# EasyEDA Pro project FPGA-G1.eprj, board logi Pi (continued)
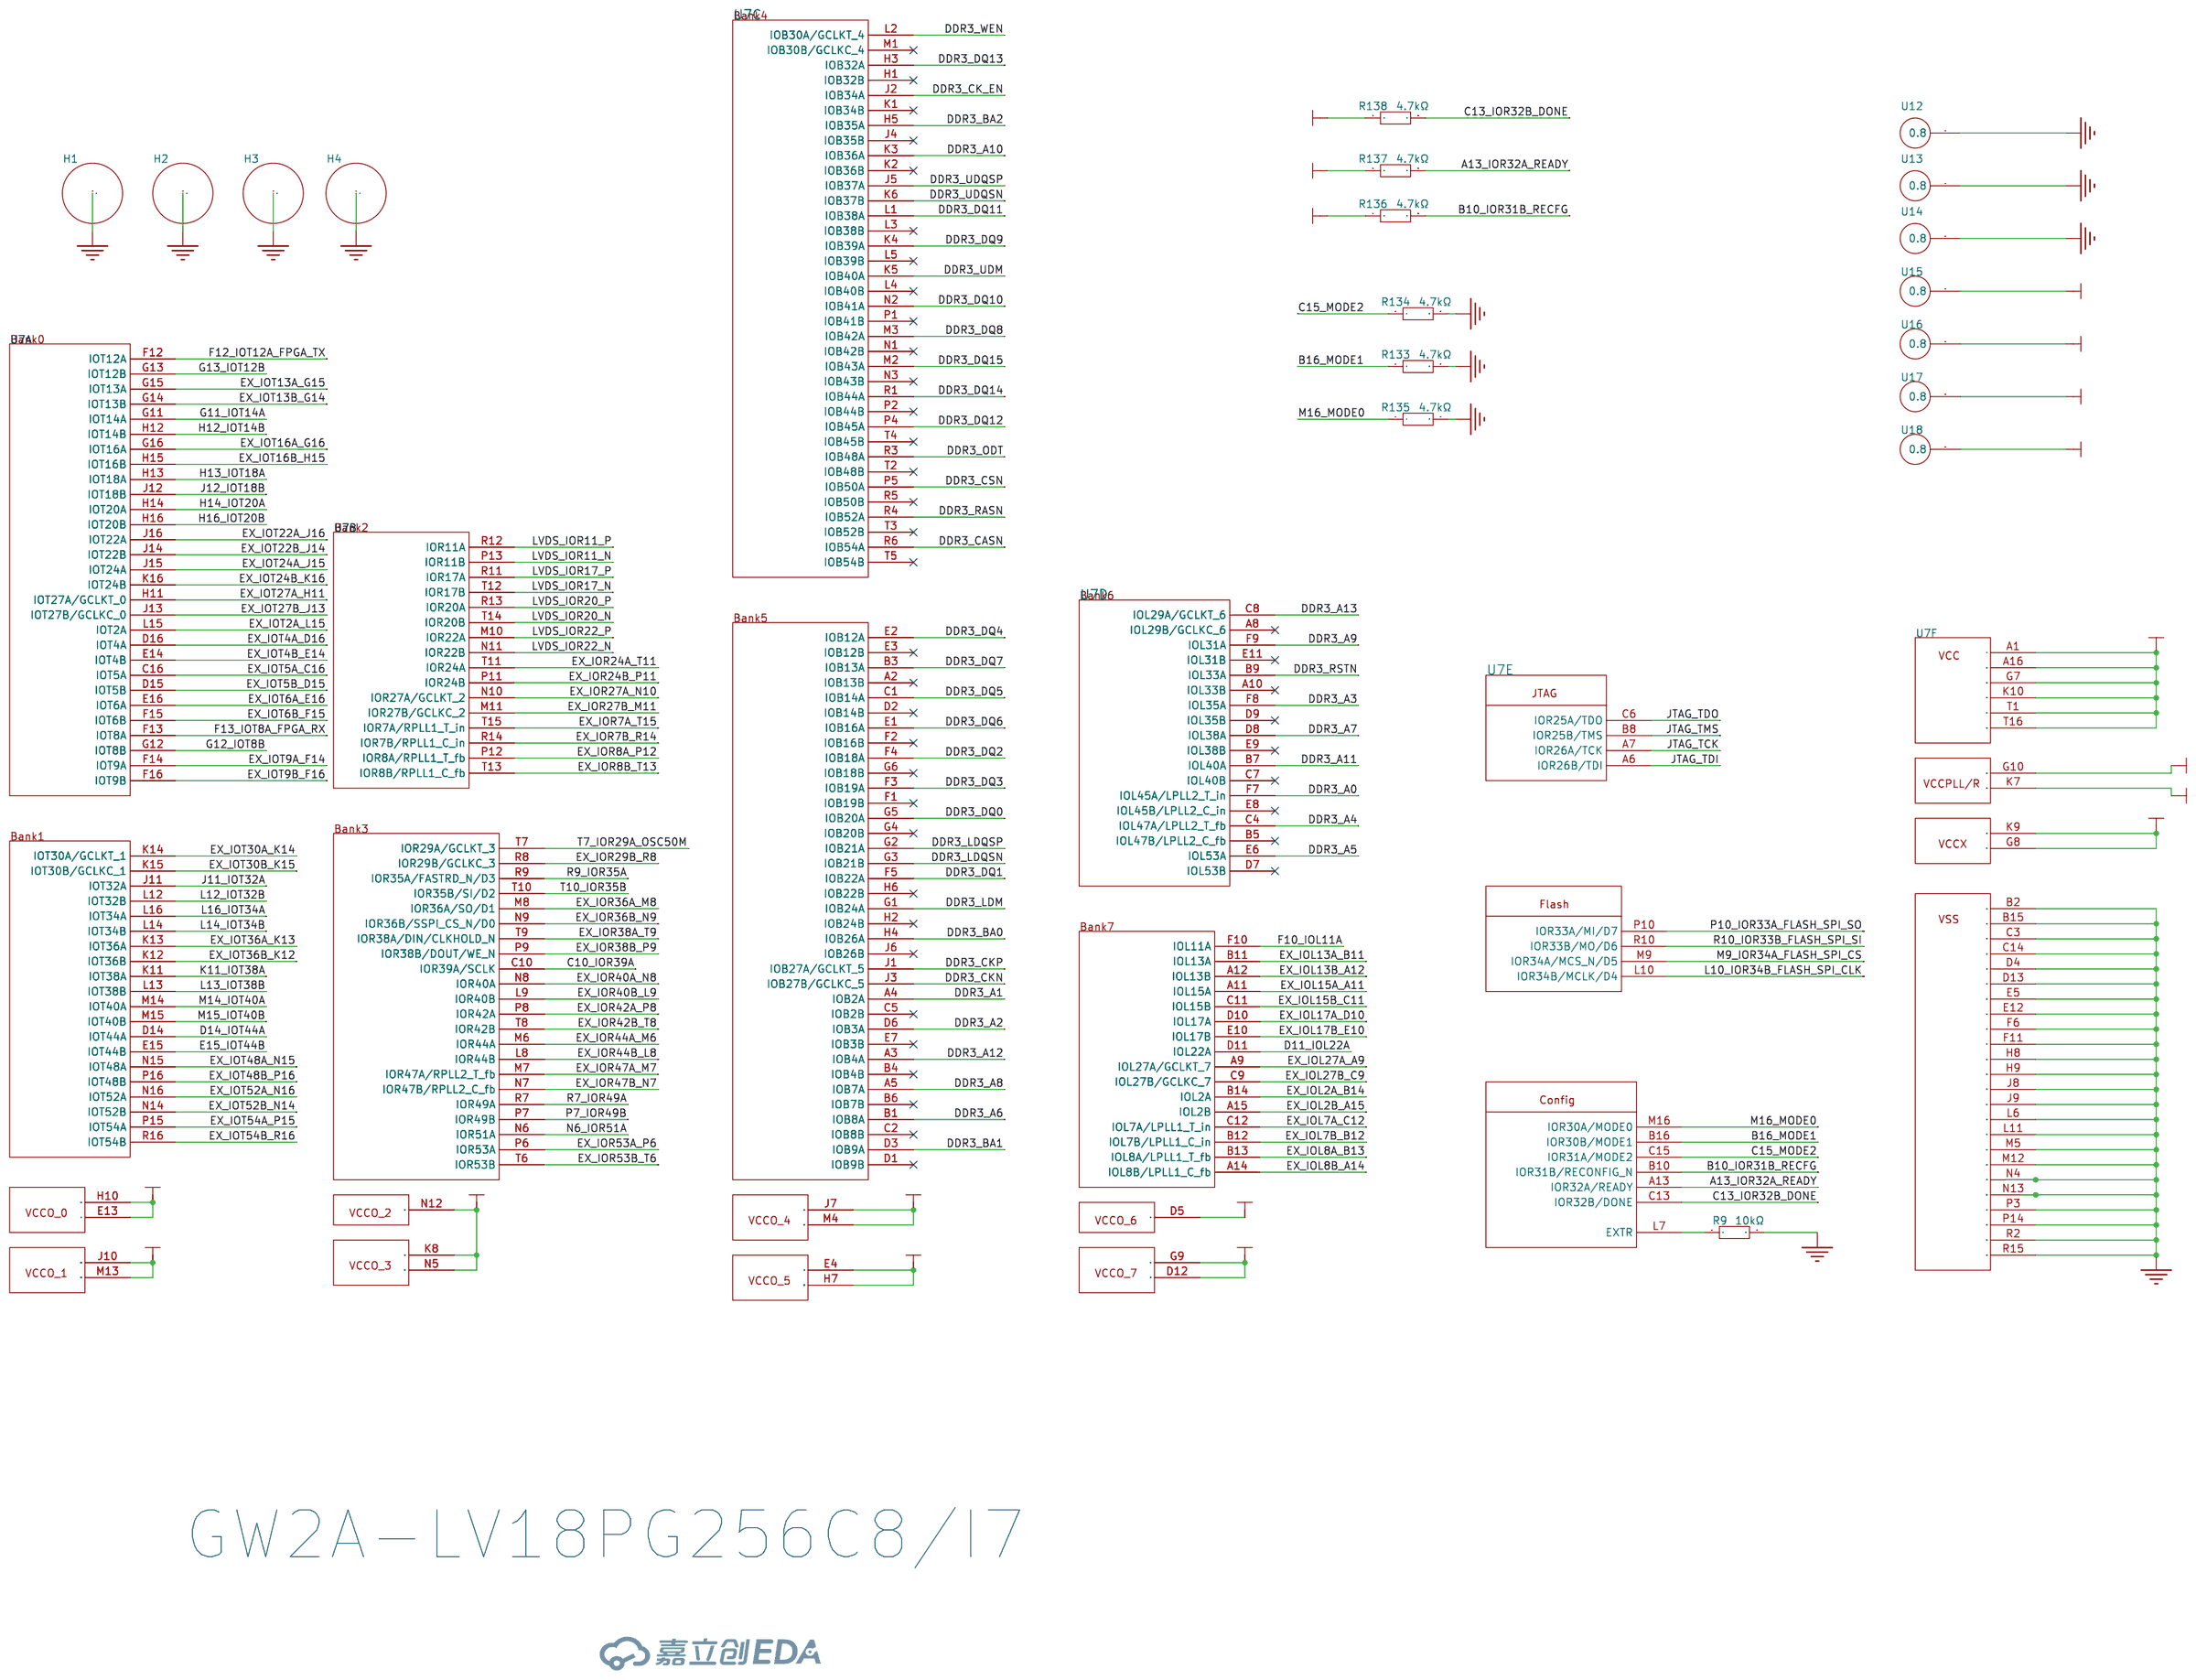
[diagram p0: FPGA]
## Placement (name value [footprint] x y rotation side) (continued)
X3  50MHz  [OSC-SMD_4P-L3.2-W2.5-BL]  24.46 22.8 0 top

## Footprints (pads in the part's own frame, mm; a bottom-side part is the same pattern mirrored in y, then rotated)
125 X 300
  round 1.016 hole 1.021x1.016: 1(4.95,-0.127) 1(6.017,2.078) 1(6.22,-2.159) 1(8.506,-2.159) 1(8.71,2.078) 1(9.903,-0.254)
  round 6.5 hole 3.18x3.175: 1(7.363,0)
C0402
  rect 0.79x0.54 smd: 1(-0.545,0) 2(0.545,0)
C0603
  rect 0.8x0.9 smd: 1(-0.7,0) 2(0.7,0)
CONN-SMD_6P-P1.00_XUNPU_WAFER-100W-6P
  rect 0.5x1.2 smd: 1(-2.5,1.95) 2(-1.5,1.95) 3(-0.5,1.95) 4(0.5,1.95) 5(1.5,1.95) 6(2.5,1.95)
  rect 1.8x2.5 smd: 7(3.7,-1.95) 8(-3.7,-1.95)
CONN-SMD_8P-P1.00_MEGASTAR_ZX-SH1.0-8PWT
  rect 0.5x1.7 smd: 1(-3.5,1.7) 2(-2.5,1.7) 3(-1.5,1.7) 4(-0.5,1.7) 5(0.5,1.7) 6(1.5,1.7) 7(2.5,1.7) 8(3.5,1.7)
  rect 1.8x2.8 smd: 9(4.6,-1.7) 10(-4.6,-1.7)
D0402-BI
  rect 0.6x0.6 smd: 1(-0.5,0) 2(0.5,0)
DFN2510-10_L2.5-W1.0-P0.50-BL
  rect 0.2x0.665 smd: 1(-1,-0.433) 2(-0.5,-0.433) 4(0.5,-0.433) 5(1,-0.433) 6(1,0.433) 7(0.5,0.433) 9(-0.5,0.433) 10(-1,0.433)
  rect 0.4x0.665 smd: 3(0,-0.433) 8(0,0.433)
FBGA-96_L14.0-W9.0-R16-C6-P0.80-TL
  round 0.457 smd: A1(-3.2,6) A2(-2.4,6) A3(-1.6,6) A7(1.6,6) A8(2.4,6) A9(3.2,6) B1(-3.2,5.2) B2(-2.4,5.2) B3(-1.6,5.2) B7(1.6,5.2) B8(2.4,5.2) B9(3.2,5.2) C1(-3.2,4.4) C2(-2.4,4.4) C3(-1.6,4.4) C7(1.6,4.4) C8(2.4,4.4) C9(3.2,4.4) D1(-3.2,3.6) D2(-2.4,3.6) D3(-1.6,3.6) D7(1.6,3.6) D8(2.4,3.6) D9(3.2,3.6) E1(-3.2,2.8) E2(-2.4,2.8) E3(-1.6,2.8) E7(1.6,2.8) E8(2.4,2.8) E9(3.2,2.8) F1(-3.2,2) F2(-2.4,2) F3(-1.6,2) F7(1.6,2) F8(2.4,2) F9(3.2,2) G1(-3.2,1.2) G2(-2.4,1.2) G3(-1.6,1.2) G7(1.6,1.2) G8(2.4,1.2) G9(3.2,1.2) H1(-3.2,0.4) H2(-2.4,0.4) H3(-1.6,0.4) H7(1.6,0.4) H8(2.4,0.4) H9(3.2,0.4) J1(-3.2,-0.4) J2(-2.4,-0.4) J3(-1.6,-0.4) J7(1.6,-0.4) J8(2.4,-0.4) J9(3.2,-0.4) K1(-3.2,-1.2) K2(-2.4,-1.2) K3(-1.6,-1.2) K7(1.6,-1.2) K8(2.4,-1.2) K9(3.2,-1.2) L1(-3.2,-2) L2(-2.4,-2) L3(-1.6,-2) L7(1.6,-2) L8(2.4,-2) L9(3.2,-2) M1(-3.2,-2.8) M2(-2.4,-2.8) M3(-1.6,-2.8) M7(1.6,-2.8) M8(2.4,-2.8) M9(3.2,-2.8) N1(-3.2,-3.6) N2(-2.4,-3.6) N3(-1.6,-3.6) N7(1.6,-3.6) N8(2.4,-3.6) N9(3.2,-3.6) P1(-3.2,-4.4) P2(-2.4,-4.4) P3(-1.6,-4.4) P7(1.6,-4.4) P8(2.4,-4.4) P9(3.2,-4.4) R1(-3.2,-5.2) R2(-2.4,-5.2) R3(-1.6,-5.2) R7(1.6,-5.2) R8(2.4,-5.2) R9(3.2,-5.2) T1(-3.2,-6) T2(-2.4,-6) T3(-1.6,-6) T7(1.6,-6) T8(2.4,-6) T9(3.2,-6)
FBGA-256_L17.0-W17.0-R16-C16-P1.00-TL-1
  round 0.4 smd: A1(-7.5,7.5) A2(-6.5,7.5) A3(-5.5,7.5) A4(-4.5,7.5) A5(-3.5,7.5) A6(-2.5,7.5) A7(-1.5,7.5) A8(-0.5,7.5) A9(0.5,7.5) A10(1.5,7.5) A11(2.5,7.5) A12(3.5,7.5) A13(4.5,7.5) A14(5.5,7.5) A15(6.5,7.5) A16(7.5,7.5) B1(-7.5,6.5) B2(-6.5,6.5) B3(-5.5,6.5) B4(-4.5,6.5) B5(-3.5,6.5) B6(-2.5,6.5) B7(-1.5,6.5) B8(-0.5,6.5) B9(0.5,6.5) B10(1.5,6.5) B11(2.5,6.5) B12(3.5,6.5) B13(4.5,6.5) B14(5.5,6.5) B15(6.5,6.5) B16(7.5,6.5) C1(-7.5,5.5) C2(-6.5,5.5) C3(-5.5,5.5) C4(-4.5,5.5) C5(-3.5,5.5) C6(-2.5,5.5) C7(-1.5,5.5) C8(-0.5,5.5) C9(0.5,5.5) C10(1.5,5.5) C11(2.5,5.5) C12(3.5,5.5) C13(4.5,5.5) C14(5.5,5.5) C15(6.5,5.5) C16(7.5,5.5) D1(-7.5,4.5) D2(-6.5,4.5) D3(-5.5,4.5) D4(-4.5,4.5) D5(-3.5,4.5) D6(-2.5,4.5) D7(-1.5,4.5) D8(-0.5,4.5) D9(0.5,4.5) D10(1.5,4.5) D11(2.5,4.5) D12(3.5,4.5) D13(4.5,4.5) D14(5.5,4.5) D15(6.5,4.5) D16(7.5,4.5) E1(-7.5,3.5) E2(-6.5,3.5) E3(-5.5,3.5) E4(-4.5,3.5) E5(-3.5,3.5) E6(-2.5,3.5) E7(-1.5,3.5) E8(-0.5,3.5) E9(0.5,3.5) E10(1.5,3.5) E11(2.5,3.5) E12(3.5,3.5) E13(4.5,3.5) E14(5.5,3.5) E15(6.5,3.5) E16(7.5,3.5) F1(-7.5,2.5) F2(-6.5,2.5) F3(-5.5,2.5) F4(-4.5,2.5) F5(-3.5,2.5) F6(-2.5,2.5) F7(-1.5,2.5) F8(-0.5,2.5) F9(0.5,2.5) F10(1.5,2.5) F11(2.5,2.5) F12(3.5,2.5) F13(4.5,2.5) F14(5.5,2.5) F15(6.5,2.5) F16(7.5,2.5) G1(-7.5,1.5) G2(-6.5,1.5) G3(-5.5,1.5) G4(-4.5,1.5) G5(-3.5,1.5) G6(-2.5,1.5) G7(-1.5,1.5) G8(-0.5,1.5) G9(0.5,1.5) G10(1.5,1.5) G11(2.5,1.5) G12(3.5,1.5) G13(4.5,1.5) G14(5.5,1.5) G15(6.5,1.5) G16(7.5,1.5) H1(-7.5,0.5) H2(-6.5,0.5) H3(-5.5,0.5) H4(-4.5,0.5) H5(-3.5,0.5) H6(-2.5,0.5) H7(-1.5,0.5) H8(-0.5,0.5) H9(0.5,0.5) H10(1.5,0.5) H11(2.5,0.5) H12(3.5,0.5) H13(4.5,0.5) H14(5.5,0.5) H15(6.5,0.5) H16(7.5,0.5) J1(-7.5,-0.5) J2(-6.5,-0.5) J3(-5.5,-0.5) J4(-4.5,-0.5) J5(-3.5,-0.5) J6(-2.5,-0.5) J7(-1.5,-0.5) J8(-0.5,-0.5) J9(0.5,-0.5) J10(1.5,-0.5) J11(2.5,-0.5) J12(3.5,-0.5) J13(4.5,-0.5) J14(5.5,-0.5) J15(6.5,-0.5) J16(7.5,-0.5) K1(-7.5,-1.5) K2(-6.5,-1.5) K3(-5.5,-1.5) K4(-4.5,-1.5) K5(-3.5,-1.5) K6(-2.5,-1.5) K7(-1.5,-1.5) K8(-0.5,-1.5) K9(0.5,-1.5) K10(1.5,-1.5) K11(2.5,-1.5) K12(3.5,-1.5) K13(4.5,-1.5) K14(5.5,-1.5) K15(6.5,-1.5) K16(7.5,-1.5) L1(-7.5,-2.5) L2(-6.5,-2.5) L3(-5.5,-2.5) L4(-4.5,-2.5) L5(-3.5,-2.5) L6(-2.5,-2.5) L7(-1.5,-2.5) L8(-0.5,-2.5) L9(0.5,-2.5) L10(1.5,-2.5) L11(2.5,-2.5) L12(3.5,-2.5) L13(4.5,-2.5) L14(5.5,-2.5) L15(6.5,-2.5) L16(7.5,-2.5) M1(-7.5,-3.5) M2(-6.5,-3.5) M3(-5.5,-3.5) M4(-4.5,-3.5) M5(-3.5,-3.5) M6(-2.5,-3.5) M7(-1.5,-3.5) M8(-0.5,-3.5) M9(0.5,-3.5) M10(1.5,-3.5) M11(2.5,-3.5) M12(3.5,-3.5) M13(4.5,-3.5) M14(5.5,-3.5) M15(6.5,-3.5) M16(7.5,-3.5) N1(-7.5,-4.5) N2(-6.5,-4.5) N3(-5.5,-4.5) N4(-4.5,-4.5) N5(-3.5,-4.5) N6(-2.5,-4.5) N7(-1.5,-4.5) N8(-0.5,-4.5) N9(0.5,-4.5) N10(1.5,-4.5) N11(2.5,-4.5) N12(3.5,-4.5) N13(4.5,-4.5) N14(5.5,-4.5) N15(6.5,-4.5) N16(7.5,-4.5) P1(-7.5,-5.5) P2(-6.5,-5.5) P3(-5.5,-5.5) P4(-4.5,-5.5) P5(-3.5,-5.5) P6(-2.5,-5.5) P7(-1.5,-5.5) P8(-0.5,-5.5) P9(0.5,-5.5) P10(1.5,-5.5) P11(2.5,-5.5) P12(3.5,-5.5) P13(4.5,-5.5) P14(5.5,-5.5) P15(6.5,-5.5) P16(7.5,-5.5) R1(-7.5,-6.5) R2(-6.5,-6.5) R3(-5.5,-6.5) R4(-4.5,-6.5) R5(-3.5,-6.5) R6(-2.5,-6.5) R7(-1.5,-6.5) R8(-0.5,-6.5) R9(0.5,-6.5) R10(1.5,-6.5) R11(2.5,-6.5) R12(3.5,-6.5) R13(4.5,-6.5) R14(5.5,-6.5) R15(6.5,-6.5) R16(7.5,-6.5) T1(-7.5,-7.5) T2(-6.5,-7.5) T3(-5.5,-7.5) T4(-4.5,-7.5) T5(-3.5,-7.5) T6(-2.5,-7.5) T7(-1.5,-7.5) T8(-0.5,-7.5) T9(0.5,-7.5) T10(1.5,-7.5) T11(2.5,-7.5) T12(3.5,-7.5) T13(4.5,-7.5) T14(5.5,-7.5) T15(6.5,-7.5) T16(7.5,-7.5)
FPC-SMD_18P-P0.50_FPC-05F-18PH20
  rect 0.3x1.25 smd: 1(-4.25,1.288) 2(-3.75,1.288) 3(-3.25,1.288) 4(-2.75,1.288) 5(-2.25,1.288) 6(-1.75,1.288) 7(-1.25,1.288) 8(-0.75,1.288) 9(-0.25,1.288) 10(0.25,1.288) 11(0.75,1.288) 12(1.25,1.288) 13(1.75,1.288) 14(2.25,1.288) 15(2.75,1.288) 16(3.25,1.288) 17(3.75,1.288) 18(4.25,1.288)
  rect 2x2.5 smd: 19(-5.94,-1.288) 20(5.94,-1.252)
hdmi-smd_hdmi-101s
  rect 0.2x0.84 smd: 1(1.8,2.385) 3(1.4,2.385) 5(1,2.385) 7(0.6,2.385) 9(0.2,2.385) 11(-0.2,2.385) 13(-0.6,2.385) 15(-1,2.385) 17(-1.4,2.385) 19(-1.8,2.385)
  rect 0.2x1 smd: 2(1.6,1.165) 4(1.2,1.165) 6(0.8,1.165) 8(0.4,1.165) 10(0,1.165) 12(-0.4,1.165) 14(-0.8,1.165) 16(-1.2,1.165) 18(-1.6,1.165)
  oval 1.5x2.55 hole 0.7x1.7: 20(-3.1,0.975) 20(-3.1,-2.385) 20(3.1,0.975) 20(3.1,-2.385)
HDR-TH_40P-P2.54-V-M-R2-C20-S2.54
  rect 1.575x1.8 hole 1.1: 1(-24.13,-1.27)
  round 1.8 hole 1.1: 2(-24.13,1.27) 3(-21.59,-1.27) 4(-21.59,1.27) 5(-19.05,-1.27) 6(-19.05,1.27) 7(-16.51,-1.27) 8(-16.51,1.27) 9(-13.97,-1.27) 10(-13.97,1.27) 11(-11.43,-1.27) 12(-11.43,1.27) 13(-8.89,-1.27) 14(-8.89,1.27) 15(-6.35,-1.27) 16(-6.35,1.27) 17(-3.81,-1.27) 18(-3.81,1.27) 19(-1.27,-1.27) 20(-1.27,1.27) 21(1.27,-1.27) 22(1.27,1.27) 23(3.81,-1.27) 24(3.81,1.27) 25(6.35,-1.27) 26(6.35,1.27) 27(8.89,-1.27) 28(8.89,1.27) 29(11.43,-1.27) 30(11.43,1.27) 31(13.97,-1.27) 32(13.97,1.27) 33(16.51,-1.27) 34(16.51,1.27) 35(19.05,-1.27) 36(19.05,1.27) 37(21.59,-1.27) 38(21.59,1.27) 39(24.13,-1.27) 40(24.13,1.27)
IND-SMD_L4.4-W4.2
  rect 1.4x2.12 smd: 1(2.028,0) 2(-2.028,0)
KEY-SMD_B3U-1000PM
  rect 0.8x1.7 smd: 1(-1.7,0) 2(1.7,0)
L0402
  rect 0.79x0.54 smd: 1(-0.545,0) 2(0.545,0)
L0603
  rect 0.8x0.864 smd: 1(-0.7,0) 2(0.7,0)
LED0603-RD
  rect 0.8x0.8 smd: 1(-0.799,0) 2(0.799,0)
LED-SEG-SMD_SLS0281FR1A1GD
  rect 1x2 smd: 1(-3,-6) 2(-1.5,-6) 3(0,-6) 4(1.5,-6) 5(3,-6) 6(3,6) 7(1.5,6) 8(0,6) 9(-1.5,6) 10(-3,6)
LED-SMD_4P-L1.6-W1.6-TL-FD
  rect 0.6x0.7 smd: 1(-0.7,0.5) 2(0.7,0.5) 3(-0.7,-0.5) 4(0.7,-0.5)
LQFP-48_L7.0-W7.0-P0.50-LS9.0-BL
  oval 0.27x1.5 smd: 1(-2.75,-4.25) 2(-2.25,-4.25) 3(-1.75,-4.25) 4(-1.25,-4.25) 5(-0.75,-4.25) 6(-0.25,-4.25) 7(0.25,-4.25) 8(0.75,-4.25) 9(1.25,-4.25) 10(1.75,-4.25) 11(2.25,-4.25) 12(2.75,-4.25) 25(2.75,4.25) 26(2.25,4.25) 27(1.75,4.25) 28(1.25,4.25) 29(0.75,4.25) 30(0.25,4.25) 31(-0.25,4.25) 32(-0.75,4.25) 33(-1.25,4.25) 34(-1.75,4.25) 35(-2.25,4.25) 36(-2.75,4.25)
  oval 1.5x0.27 smd: 13(4.25,-2.75) 14(4.25,-2.25) 15(4.25,-1.75) 16(4.25,-1.25) 17(4.25,-0.75) 18(4.25,-0.25) 19(4.25,0.25) 20(4.25,0.75) 21(4.25,1.25) 22(4.25,1.75) 23(4.25,2.25) 24(4.25,2.75) 37(-4.25,2.75) 38(-4.25,2.25) 39(-4.25,1.75) 40(-4.25,1.25) 41(-4.25,0.75) 42(-4.25,0.25) 43(-4.25,-0.25) 44(-4.25,-0.75) 45(-4.25,-1.25) 46(-4.25,-1.75) 47(-4.25,-2.25) 48(-4.25,-2.75)
OSC-SMD_4P-L3.2-W2.5-BL
  rect 1.4x1.2 smd: 1(-1.1,-0.875) 2(1.1,-0.875) 3(1.1,0.875) 4(-1.1,0.875)
R0402
  rect 0.566x0.54 smd: 1(-0.433,0) 2(0.433,0)
R0603
  rect 0.806x0.864 smd: 1(-0.753,0) 2(0.753,0)
RES-ARRAY-SMD_0402-8P-L2.0-W1.0-BL
  rect 0.3x0.505 smd: 1(-0.75,0.427) 2(-0.25,0.427) 3(0.25,0.427) 4(0.75,0.427) 5(0.75,-0.427) 6(0.25,-0.427) 7(-0.25,-0.427) 8(-0.75,-0.427)
SOD-323_L1.8-W1.3-LS2.5-RD
  rect 1x0.75 smd: 1(-1.173,0) 2(1.173,0)
SOP-8_L5.3-W5.3-P1.27-LS8.0-BL
  oval 0.609x2.204 smd: 1(-1.905,-3.542) 2(-0.635,-3.542) 3(0.635,-3.542) 4(1.905,-3.542) 5(1.905,3.542) 6(0.635,3.542) 7(-0.635,3.542) 8(-1.905,3.542)
SOT-23-3_L3.0-W1.7-P0.95-LS2.9-BR
  rect 1.038x0.532 smd: 1(1.101,-0.95) 2(1.101,0.95) 3(-1.101,0)
SW-SMD_4P-L4.2-W3.3-P2.15-LS5.1
  rect 1.3x0.7 smd: 1(-2.25,1.075) 2(2.25,1.075) 3(-2.25,-1.075) 4(2.25,-1.075)
Test-Point-0.5mm
  round 1 smd: 1(0,0)
TF-SMD_TF-PUSH
  rect 0.7x1.6 smd: 1(2.25,5.3) 2(1.15,5.3) 3(0.05,5.3) 4(-1.05,5.3) 5(-2.15,5.3) 6(-3.25,5.3) 7(-4.35,5.3) 8(-5.45,5.3) CD(-6.55,5.3)
  rect 1.2x1.5 smd: 10(-7.75,4.3)
  rect 1.2x2.2 smd: 11(-7.75,-5.3) 12(7.75,-5.3)
  rect 1.6x1.5 smd: 13(6.85,4.3)
TSOT-23-6_L2.9-W1.6-P0.95-LS2.8-BR
  rect 0.8x0.532 smd: 1(1.2,-0.95) 2(1.2,0) 3(1.2,0.95) 4(-1.2,0.95) 5(-1.2,0) 6(-1.2,-0.95)
USB-C-SMD_TYPE-C-6PIN-2MD-073
  rect 0.6x1.1 smd: 1(-3.2,2.375) 2(-2.4,2.375) 11(2.4,2.375) 12(3.2,2.375)
  rect 0.3x1.1 smd: 3(-1.75,2.375) 4(-1.25,2.375) 5(-0.75,2.375) 6(-0.25,2.375) 7(0.25,2.375) 8(0.75,2.375) 9(1.25,2.375) 10(1.75,2.375)
  oval 1.2x2 hole 0.6x1.5: 13(-4.325,1.825) 14(4.325,1.825)
  oval 1.2x1.8 hole 0.6x1.2: 13(-4.325,-2.375) 14(4.325,-2.375)
WSON-10_L3.0-W3.0-P0.50-BL-EP
  rect 0.25x0.6 smd: 1(-1.001,-1.4) 2(-0.5,-1.4) 3(0,-1.4) 4(0.5,-1.4) 5(1.001,-1.4) 6(1.001,1.4) 7(0.5,1.4) 8(0,1.4) 9(-0.5,1.4) 10(-1.001,1.4)
  custom 3.4x1.65 smd: 11(0,0)
测试点0.8mm
  round 0.8 smd: 1(0,0)

## Nets
As in the schematic.

Pads without a net: CARD2 1 8 CD; CN1 7 8; FPC1 1 2 3 4 19 20; H6 12; U1 3 4; U7 A2 A8 A10 B4 B5 B6 C2 C5 C7 D1 D2 D7 D9 E3 E7 E8 E9 E11 F1 F2 G4 G6 H1 H2 H6 J4 J6 K1 K2 L3 L4 L5 M1 N1 N3 P1 P2 R5 T2 T3 T4 T5; U29 J1 J9 L1 L9 M7 T7; USB2 3 9; USB3 2

## Via types
v1: diameter 0.457, hole 0.305, Top Layer to Bottom Layer, 674 vias

## Routing (per net, layer and track width the routed paths; a pad name or vN(x,y) marks a point on that pad's centre or on a via; arc(x,y) is an arc through that point)
+1.0V: length 35.5
  Top Layer w0.381: U7.T16 v1(35.7,28.09) ; 19.84,45.74 20.04,45.54 20.83,45.54 ; v1(35.7,44.09) U7.A16 ; U7.A1 20.14,43.59 v1(19.7,44.03) 19.7,45.38 19.68,45.4 ; U7.G7 v1(25.7,38.09) ; v1(26.28,1.36) C191.2 ; U7.T1 v1(19.7,28.09) ; U7.K10 v1(28.7,35.09)
  Bottom Layer w0.381: L12.1 31.51,46.14 32.55,46.14 32.9,45.79 32.9,44.94 33.03,44.81 C157.2 35.79,44.81 ; v1(28.7,35.09) 29.63,34.16 29.8,34.16 30.01,34.37 31.22,34.37 ; C151.2 35.79,44.18 v1(35.7,44.09) ; C153.2 34.67,27.7 34.67,27.7 34.62,27.74 ; 25.51,38.04 25.07,37.61 25.07,37.02 24.95,36.89 25.07,36.76 ; 25.63,1.32 26.25,1.32 v1(26.28,1.36) 26.65,1.73 26.65,11.3 v1(26.35,11.6) ; 26.99,11.26 26.39,11.26 26.35,11.22 ; 18.32,26.54 18.32,26.71 v1(19.7,28.09) 20.25,28.09 20.52,27.82 L13.1 ; 36.03,27.27 36.03,27.75 35.75,28.03
  vias: v1(26.38,10.93) v1(26.38,10.36) v1(26.99,11.64) v1(27.02,10.95) v1(27.02,10.38)
+1.5V: length 57.1
  Top Layer w0.254: 16.66,40.2 U29.R1
  Top Layer w0.381: U7.H7 v1(25.7,37.09) ; 8.08,30.85 8.88,30.85 ; U29.E9 v1(9.5,31.44) 8.89,30.83 ; 9.42,33.87 9.29,34 7.97,34 ; C97.2 8.22,40.24 v1(9.5,40.24) U29.R9 ; 9.49,38.65 9.19,38.95 8.05,38.95 ; U29.K2 15.51,35.84 v1(15.91,36.24) ; U29.A1 v1(16.7,28.24) ; v1(16.7,28.24) 16.7,27.63 16.51,27.44 ; v1(16.7,28.24) 17.25,27.69 18.35,27.69 18.36,27.7 ; v1(15.88,33.85) 15.5,34.23 U29.H2 ; U29.N1 16.48,38.24 v1(16.87,38.63) 17.34,38.63 17.75,38.22 18.29,38.22 18.29,38.22 ; 16.21,20.95 16.83,20.95 v1(16.97,21.09) ; U29.H9 v1(9.5,33.84) ; U29.A8 v1(10.3,28.24) 10.3,27.5 9.84,27.04 C104.2 ; 16.66,40.2 17.51,41.05 v1(17.51,41.06) ; 17.51,41.05 18.2,40.36 C33.2 ; C103.2 16.7,29.84 U29.C1 v1(15.9,30.64) U29.D2 ; U7.D5 v1(23.7,41.09) ; U29.G7 v1(11.1,33.04) ; 8.1,29.3 8.92,29.3 ; U29.F1 v1(16.7,32.24) 17.43,32.24 17.73,31.94 C105.2 ; 8.94,29.28 v1(9.5,29.84) U29.C9 ; C184.2 v1(20.72,18.82) ; U29.K8 v1(10.3,36.24) ; U7.E4 v1(22.7,40.09) ; U7.J7 v1(25.7,35.09) ; v1(9.5,38.64) U29.N9 ; U29.B2 v1(15.9,29.04) ; U7.M4 v1(22.7,32.09) ; U29.D9 v1(9.5,30.64)
  SIG03 w0.381: 9.54,40.27 9.53,40.29
  Bottom Layer w0.381: v1(9.24,18.78) 10.2,19.73 19.8,19.73 v1(20.72,18.82) 20.72,18.82 R166.2 ; C147.2 23.73,41.14 C27.2 ; 24.63,35.99 24.86,35.75 C146.2 25.7,35.57 v1(25.7,35.09) ; v1(9.5,29.84) 9.33,29.68 C144.2 ; C98.2 9.37,33.97 v1(9.5,33.84) ; v1(15.91,36.24) 15.84,36.18 15.17,36.18 ; C31.2 8.28,30.84 8.92,30.84 9.49,31.42
  vias: v1(8.6,18.78) v1(8.6,18.13) v1(8.6,17.54) v1(9.24,18.13) v1(9.25,17.54) v1(16.99,20.45)
+3.3V: length 75.3
  Top Layer w0.254: U1.9 31.34,53.2 v1(31.56,53.41) ; v1(27.25,61.26) 27.34,61.17 27.34,61.04 ; 26.64,50.47 26.46,50.29 26.46,49.61 ; 35.3,59.16 35.11,58.96 34.64,58.96 ; 23.71,53.47 25.41,53.47 25.42,53.48 ; 27.35,51.43 27.35,51.18 27,50.83
  Top Layer w0.305: 29.54,62.87 29.54,63.18 29.51,63.21 v1(29.51,63.22) 29.53,63.24 29.53,63.73
  Top Layer w0.381: v1(37.72,25.01) 37.49,25.24 C57.1 36.19,25.24 ; U7.K8 v1(26.7,34.09) ; C177.2 v1(21.11,1.37) ; v1(25.77,49.61) C170.2 ; 33.32,46.93 34.22,46.93 34.23,46.94 ; 18.58,23.1 18.58,23.11 v1(18.58,23.45) ; v1(33.6,47.78) 33.32,47.5 R137.1 ; v1(22.28,56.35) 22.11,56.18 LED1.2 ; 13.31,58.54 v1(13.31,60.07) ; v1(23.63,52.8) 23.63,53.37 23.73,53.47 23.73,53.56 ; U7.G9 v1(28.7,38.09) ; U7.G8 v1(26.7,38.09) ; U7.E13 v1(31.7,40.09) ; R176.2 v1(10.37,64.75) ; U7.N12 v1(30.7,32.09) ; 36.47,60.2 v1(36.47,60.81) ; U7.K9 v1(27.7,35.09) ; v1(7.79,12.25) 8.62,11.41 8.62,10.44 ; 26.17,20.46 v1(26.98,20.46) ; 13.23,47.04 13.29,47.1 v1(13.29,47.85) ; v1(15.92,53.85) 16.9,54.82 17.93,54.82 ; R61.2 27.51,14.49 31.16,14.49 31.58,14.07 31.58,13.68 31.91,13.35 R6.2 33.03,13.35 ; 37.14,24.23 37.14,25.03 ; 16.05,10.43 16.05,11.05 ; 21.28,60.08 20.93,59.73 SW5.2 ; 22.24,13.27 20.83,13.27 ; 36.47,60.09 36.49,60.09 ; 37.23,25.21 37.2,25.18 ; U7.J10 v1(29.72,36.11) ; 35.3,59.16 36.23,60.09 ; U7.N5 v1(23.7,31.09) ; 8.65,19.96 7.94,19.96 v1(7.92,19.94) ; U7.H10 v1(28.69,37.11) ; 21.11,23.12 21.14,23.15 v1(21.14,23.43) ; U7.M13 v1(32.7,32.09) ; U7.D12 v1(31.7,41.09) ; 26.99,50.83 26.64,50.47
  SIG04 w0.381: v1(18.58,23.45) 21.12,23.45 v1(21.14,23.43)
  Bottom Layer w0.381: v1(28.7,38.09) 28.15,38.65 C160.2 ; v1(18.56,50.34) 17.57,50.34 16.34,49.11 14.35,49.11 13.29,48.05 v1(13.29,47.85) ; 28.82,62.95 29.26,62.95 29.49,63.18 ; 15.93,54.69 15.93,53.83 v1(15.92,53.85) ; 31.74,41.09 30.65,42.17 30.55,42.17 ; v1(30.7,32.09) 30.9,31.9 C116.2 ; v1(27.25,61.26) 27.25,60.68 R2.2 ; R37.2 21.1,1.35 v1(21.11,1.37) 21.49,1.75 21.49,9.74 20.9,10.34 v1(20.9,12.92) ; 27.03,20.43 27.57,20.43 28,20.86 28,22.63
  vias: v1(7.92,20.58) v1(16.05,11.07) v1(19.65,13.57) v1(19.65,12.92) v1(20.28,13.57) v1(20.28,12.92) v1(20.9,13.57) v1(21.28,60.14) v1(33.05,13.35)
+5V_IN: length 92.8
  Top Layer w0.381: 33.82,6.09 33.84,6.11 33.84,6.44 34.31,6.91 ; 34.91,9.46 34.91,8.69 34.77,8.49 34.29,8.01 34.29,8.29 34.15,8.43 ; USB2.2 29.51,6.89 29.95,6.45 29.95,6.1 ; 29.66,8.43 29.51,8.28 29.51,8 29.01,8.5
  Top Layer w0.508: U20.8 12.51,63.34
  Top Layer w0.635: 34.29,7.41 34.29,8.01 ; USB2.2 29.51,8
  Bottom Layer w0.381: v1(15.78,16.78) 15.78,17.69 R157.2 ; 37.38,59.7 37.38,57.2 37.83,56.75 43.67,56.75 43.75,56.83 ; 37.38,59.7 37.38,61.14 38.04,61.8 ; 37.38,59.7 37.74,59.34 42.76,59.34 43.14,59.72 v1(43.14,60.24) 43.14,61.44 42.76,61.82 38.03,61.82 v1(36.14,63.71) ; R36.2 20.23,6.3 v1(19.27,6.3) ; 33.99,64.7 35.55,64.7 35.83,64.42 35.83,63.8 ; R161.2 25.51,6.24 v1(24.5,6.24)
  Bottom Layer w1.016: v1(44.05,59.37) 43.75,59.07 43.75,12.81 43.19,12.25 41.65,12.25 H6.40 ; v1(36.14,63.71) 36.21,63.71
  vias: v1(9,63.42) v1(9,62.44) v1(9.71,63.42) v1(9.71,62.44) v1(15.77,16.16) v1(16.4,16.8) v1(16.39,16.16) v1(18.66,6.31) v1(18.66,5.69) v1(19.29,5.68) v1(23.88,6.25) v1(23.88,5.63) v1(24.52,5.62) v1(29.01,8.52) v1(29.66,8.52) v1(29.95,6.11) v1(30.75,6.11) v1(31.47,6.11) v1(32.24,6.11) v1(33.04,6.11) v1(33.82,6.11) v1(34.15,8.52) v1(34.8,8.52) v1(35.51,64.36) v1(35.48,63.74) v1(36.17,64.36) v1(43.14,59.37) v1(44.07,60.24)
GND: length 295.2
  Top Layer w0.203: 11.55,7.44 11.55,8.61 11.39,8.76 ; 10.95,6.22 v1(10.95,5.3) ; 12.75,7.34 12.75,8.26 ; 13.35,6.2 13.35,5.28 ; 12.14,6.2 12.14,5.28
  Top Layer w0.254: 35.83,58.91 35.42,58.5 34.86,58.5 ; 24.68,62.46 25.54,63.32 25.54,63.82 ; U29.B3 v1(15.1,29.04) ; 29.05,64.41 29.05,65.8 29.04,65.8 ; 27.85,60.86 27.85,60.87 v1(27.85,61.29) ; U23.8 11.78,22.75 ; 25.49,53.95 v1(24.66,53.95) ; 30.85,52.4 30.84,52.41 ; U23.4 12.63,23.25
  Top Layer w0.305: U29.E1 v1(16.7,31.44) ; 16.74,31.4 17.41,31.4 17.88,30.93 ; 16.3,37.44 v1(16.7,37.04)
  Top Layer w0.381: U29.P1 16.85,39.6 18.7,39.6 ; 27.79,17.67 27.78,17.66 27.12,17.66 ; U29.J8 v1(10.3,35.44) ; 8.07,37.73 9.36,37.73 9.48,37.86 ; v1(16.11,26.74) 16.1,26.74 15.69,26.74 15.42,27.01 C35.1 ; LED4.1 v1(8.3,68.93) ; v1(9.5,37.84) U29.M9 ; 29.82,10.5 v1(29.82,11.06) ; 16.81,41.21 17.24,41.65 18.25,41.65 18.45,41.45 ; 28.07,8.5 28.72,7.84 28.72,7.5 ; v1(22.25,68.16) U20.10 v1(18.74,68.16) ; v1(11.3,11.05) 11.3,10.49 ; C56.1 22.35,20.02 v1(22.22,20.02) 22,20.25 22,21.04 v1(22,21.05) v1(22,22.96) 22.01,22.97 v1(22.01,24.02) v1(22.01,24.69) 22.09,24.76 v1(23.09,24.76) 23.95,24.76 24.06,24.87 ; 28.5,7.34 27.88,7.34 ; R104.2 29.89,10.45 E1.1 ; X1.2 27.36,48.16 27.25,48.05 ; U29.B1 v1(16.7,29.04) ; v1(26.12,17.67) 25.81,17.97 SW3.4 ; R156.1 20.66,3.15 v1(19.93,3.15) ; R135.2 36.48,31.78 v1(36.25,31.56) ; 27.15,15.35 27.81,15.35 ; v1(29.58,13.31) 29.59,13.32 30.51,13.32 ; C75.1 C76.1 16.02,22.94 v1(16.02,23.45) ; U7.H8 v1(26.7,37.09) ; U7.L11 v1(30.7,33.09) ; U29.G1 16.71,33.04 v1(16.74,33.04) 16.75,33.03 C105.1 ; 16.88,29.07 17.34,29.07 17.78,28.63 18.33,28.63 18.38,28.69 ; U7.F11 30.22,38.59 v1(30.72,39.1) 31.2,39.58 U7.E12 ; 33.8,11 33.8,11 33.8,10.41 ; v1(17.75,0.63) 17.75,1.34 R40.1 ; U7.F6 v1(24.7,39.09) ; v1(26.1,27.07) 26.37,26.8 v1(26.37,25.95) 26.37,24.99 v1(26.66,24.7) 26.67,24.69 v1(26.67,22.55) 25.9,21.79 ; R103.2 34.61,10.36 U14.1 ; 27.67,36.1 28.19,35.59 U7.J9 ; U29.T1 v1(16.7,41.04) ; 18.5,41.43 18.5,42.58 18.41,42.67 ; 28.04,8.57 27.98,8.51 27.45,8.51 ; v1(18.93,17.43) 18.93,18.16 R158.1 ; U29.G8 v1(10.3,33.04) ; 20.68,46.78 20.49,46.97 19.95,46.97 ; U29.F9 v1(9.5,32.24) ; U7.C14 v1(32.7,41.09) U7.D13 ; 27.25,48.05 v1(27.25,46.97) 27.25,45.62 27.71,45.16 30.9,45.16 30.9,46.15 X1.4 31.69,47.47 31.69,49.14 31.27,49.56 31.58,49.88 v1(31.58,50.08) ; 27.25,48.05 v1(27.24,48.04) 26.75,48.52 C170.1 ; 27.25,48.05 27.25,49.49 ; U29.D8 v1(10.3,30.64) ; C104.1 9.44,28.24 v1(9.5,28.24) U29.A9 ; v1(24.67,27.01) 24.63,26.98 v1(24.63,25.93) 24.06,25.35 24.06,24.87 ; U1.8 30.84,50.82 v1(30.85,50.82) 30.85,49.97 30.86,49.95 30.86,49.94 31.27,49.56 ; 32.09,11.09 32.11,11.11 ; D10.3 11.31,9.59 11.39,9.5 v1(11.39,8.92) 11.39,8.91 ; R164.1 22.99,1.34 v1(22.99,0.66) ; U29.P9 v1(9.5,39.44) ; U7.J8 v1(26.7,35.09) ; 8.11,28.25 8.8,28.25 9.51,29.05 U29.B9 ; U7.B15 v1(33.7,42.09) ; v1(22.64,52.79) 22.65,52.79 22.65,53.44 ; U29.J2 v1(15.9,35.44) ; SW4.1 v1(21.17,62.57) ; R133.2 35.94,47.02 v1(35.7,47.02) 35.64,46.95 R134.2 ; v1(18.86,39.59) 18.7,39.59 18.7,39.6 ; U29.D1 v1(16.7,30.64) ; v1(17.45,60.14) R20.1 ; 22.22,17.57 22.83,17.57 v1(22.84,17.56) ; R165.1 20.71,15.22 v1(20.71,14.77) ; 18.7,39.6 18.48,39.37 ; 8.38,24.46 8.38,25.05 ; U7.E5 v1(23.7,40.09) ; D9.8 D9.3 ; 9.47,32.18 9.26,31.98 8.05,31.98 ; v1(33.95,61.75) v1(34.68,61.75) 34.67,61.77 34.67,62.9 ; U29.G9 v1(9.5,33.04) ; 36.03,17.9 v1(36.03,16.88) ; U7.D4 v1(22.7,41.09) U7.C3 ; 37.16,26.33 37.68,25.81 v1(37.72,25.81) ; R132.1 C99.1 ; 14.2,10.46 14.2,11.07 ; U20.9 v1(13.09,68.16) ; 24.06,24.87 v1(24.06,24.75) ; v1(25.19,3.09) 25.24,3.04 25.5,3.04 25.65,2.88 C189.1 ; U29.T9 9.87,40.64 v1(9.47,41.04) 9.27,41.25 8.14,41.25 ; 27.91,49.55 v1(27.26,49.55) ; 22.26,15.38 v1(22.92,15.38) ; 36.38,59.01 35.94,59.01 ; U7.M12 v1(31.7,32.09) ; U30.4 26.13,21.35 X3.2 ; U7.H9 v1(27.7,37.09) ; 30.83,17.62 v1(30.83,16.85) ; 32.33,15.33 32.99,15.33 ; 35.84,7.09 35.79,7.14 35.22,7.14 ; U7.N13 v1(32.7,31.09) U7.P14 33.62,30.17 v1(33.62,30.16) 34.19,29.59 U7.R15 34.73,29.06 34.8,29.06 ; v1(22.64,48.21) 22.26,48.59 21.5,48.59 v1(21.1,48.19) 20.85,47.93 C154.1 21.29,46.73 v1(21.94,46.08) ; U29.E8 v1(10.3,31.44) ; U20.1 v1(19.51,63.41) ; U7.N4 v1(22.7,31.09) U7.P3 v1(21.7,30.09) U7.R2 v1(20.7,29.09) ; 35.1,7.45 35.1,7.75 35.85,8.49 ; 25.66,13.53 25.66,14.64 ; 19.09,56.25 19.09,54.9 19.07,54.89 ; 27.95,49.61 28.6,50.25 v1(28.6,50.4) ; U29.M1 16.3,37.44 ; 35.98,13.58 35.98,14.42 v1(35.99,14.43) ; 32.09,10.42 32.09,11.05 ; U7.L6 v1(24.7,33.09) ; 32.38,17.59 33.04,17.59 ; U7.B2 v1(20.7,43.09) ; U29.E2 v1(15.9,31.44) ; 17.88,30.93 18.44,30.93 ; U7.M5 v1(23.7,32.09) ; 8.07,33.02 9.46,33.02
  SIG03 w0.254: v1(36.25,31.56) 36.2,31.51 36.2,30.27 36.71,29.76 36.71,20.45 35.18,18.91 33.36,18.91 33.05,18.6 v1(33.05,17.6)
  SIG03 w0.381: v1(33.62,30.16) 35.05,28.73 35.05,21.19 34.02,20.16 32.49,20.16 30.83,18.5 v1(30.83,16.85) 30.83,14.56 v1(29.58,13.31) 29.82,13.07 v1(29.82,11.06) ; v1(33.05,17.6) v1(33.05,15.34) 32.5,14.78 32.5,11.45 v1(32.11,11.06)
  Bottom Layer w0.254: C148.1 17.18,26.44 19.83,29.09 v1(20.7,29.09)
  Bottom Layer w0.381: v1(19.3,3.15) 19.15,3 C174.1 ; v1(14.09,47.85) 14.23,47.71 14.23,46.39 ; 35.34,58.52 35.44,58.52 v1(35.93,59.02) ; 9.12,46.29 9.14,46.27 9.9,46.27 ; 10.22,35.14 10.1,35.27 R131.1 ; 13.3,46.28 12.67,46.28 12.65,46.3 ; v1(26.7,35.09) 26.7,35.66 C146.1 ; v1(32.7,31.09) 32.67,31.13 C116.1 ; v1(9.5,32.24) 9.21,31.95 C31.1 C98.1 9.34,32.88 v1(9.5,33.04) v1(10.3,33.04) ; R4.1 v1(22.66,60.15) ; 33.96,61.74 33.67,61.44 33.67,60.69 ; v1(11.3,11.05) 11.02,10.77 10.29,10.77 ; 33.85,28.51 33.85,28.86 C153.1 33.62,30.15 v1(33.62,30.16) ; C85.2 C84.2 ; C84.2 10.85,46.28 10.85,47.72 ; C84.2 11.66,46.25 ; 14.42,51.08 14.43,51.09 14.43,51.79 ; 10.85,47.72 12.4,47.72 12.56,47.56 12.56,46.27 C139.2 C82.1 11.66,46.25 ; 10.85,47.72 9.09,47.72 ; C156.1 24.4,37.63 24.4,38.22 24.7,38.52 24.7,39.06 ; 10.12,10.57 10.12,9.87 9.97,9.71 ; 14.24,46.24 14.26,46.26 15.15,46.26 ; 25.81,65.64 25.8,65.63 24.78,65.63 ; v1(22.9,10.97) 22.82,11.04 C115.1 22.82,14.42 C123.1 22.92,14.52 v1(22.92,15.38) ; 15.17,35.09 15.54,35.09 v1(15.9,35.44) 16.13,35.21 C89.2 ; 9.08,46.46 9.08,47.16 ; v1(13.74,56.35) 13.73,56.34 13.73,55.11 ; v1(30.72,39.1) 30.65,39.17 C164.1 C165.1 ; 11.66,46.25 11.66,46.26 ; 9.1,47.16 9.1,47.17 ; C182.1 19.12,17.62 v1(18.93,17.43) ; v1(27.25,46.97) 27.79,46.43 C126.1 ; v1(24.56,3.09) 22.72,3.09 C188.1 ; v1(24.66,53.95) 23.85,54.77 CARD2.13 ; C144.1 8.36,28.59 8.77,28.99 9.45,28.99 9.45,29.04 ; 31,64.87 v1(31,65.81) ; 9.09,47.72 9.09,47.17 ; 9.09,47.72 v1(9.09,47.8) ; C118.1 36.45,10.78 C117.1 34.56,10.78 D8.1 33.87,11.07 v1(33.8,11.07) ; 22.64,42.02 22.64,41.15 v1(22.7,41.09) ; C88.2 9.22,38.13 9.47,37.87 9.48,37.87 ; v1(35.7,47.02) 35.79,46.93 C151.1 35.48,45.9 C157.1 ; v1(18.32,16.8) 18.32,16.48 C187.1 19.07,15.73 C181.1 ; 9.25,67.69 CARD2.11 v1(10.74,65.54) ; 33.7,23.89 33.66,23.93 v1(33.66,24.54) ; C155.1 37.72,26.89 v1(37.72,25.81) ; C173.1 28.28,61.71 v1(27.85,61.29) 28.12,61.29 C167.1 ; 14.43,52.63 14.43,51.89 ; 9.98,9.66 9.98,9.37 9.58,8.98 9.58,8.96 v1(9.61,8.92) 9.61,6.6 USB3.20 ; C130.1 24.36,26.2 v1(24.63,25.93) ; v1(19.93,3.15) 20.13,2.95 C175.1 ; R162.1 25.23,3.13 v1(25.19,3.09) ; 22.62,26.48 22.62,25.56 22.01,24.95 v1(22.01,24.69) ; C160.1 27.7,37.15 v1(27.7,37.09) ; v1(27.7,37.09) v1(27.7,36.1) 27.72,36.12 28.78,36.12 ; v1(27.7,37.09) v1(26.7,37.09) ; v1(16.11,26.74) 16.65,26.74 C148.1 ; CARD2.10 v1(8.06,55.94)
  vias: v1(0.65,65.5) v1(0.65,62.96) v1(0.65,60.42) v1(0.65,57.88) v1(0.65,55.34) v1(0.65,52.8) v1(0.65,50.26) v1(0.65,47.72) v1(0.65,45.18) v1(0.65,42.64) v1(0.65,40.1) v1(0.65,37.56) v1(0.65,35.02) v1(0.65,32.48) v1(0.65,29.94) v1(0.65,27.4) v1(0.65,24.86) v1(0.65,22.32) v1(0.65,19.78) v1(0.65,17.24) v1(0.65,14.7) v1(0.65,12.16) v1(0.65,9.62) v1(0.65,7.08) v1(0.65,4.54) v1(1.01,2.27) v1(1.06,67.82) v1(2.65,0.83) v1(3.1,69.31) v1(5.46,0.63) v1(7.95,15.25) v1(7.95,14.53) v1(8,0.63) v1(8.37,25.07) v1(8.57,15.25) v1(8.56,14.53) v1(8.9,61.1) v1(8.9,60.38) v1(9.09,47.17) v1(9.18,15.25) v1(9.18,14.53) v1(9.5,29.04) v1(9.61,61.1) v1(9.61,60.38) v1(9.78,13.19) v1(10.54,0.63) v1(11.29,13.19) v1(12.14,5.3) v1(12.8,13.19) v1(12.75,8.24) v1(13.08,0.63) v1(13.35,5.3) v1(13.46,68.93) v1(14.2,11.09) v1(14.28,13.19) v1(14.42,51.08) v1(15.62,0.63) v1(15.77,13.21) v1(16,68.93) v1(16.95,13.26) v1(16.95,12.73) v1(16.95,11.09) v1(17.68,13.26) v1(17.68,12.73) v1(17.68,11.09) v1(18.32,17.43) v1(18.54,68.93) v1(18.93,16.8) v1(19.09,56.35) v1(19.3,3.77) v1(19.88,0.63) v1(19.93,3.77) v1(22.28,10.97) v1(22.28,10.36) v1(22.42,0.63) v1(22.9,10.36) v1(23.62,68.93) v1(23.57,0.66) v1(23.7,36.09) v1(24.56,3.71) v1(24.68,62.57) v1(25.19,3.71) v1(25.66,14.77) v1(25.82,65.64) v1(26.11,0.66) v1(26.16,68.93) v1(26.66,23.39) v1(27.44,8.52) v1(27.82,17.67) v1(27.82,15.36) v1(28.08,8.52) v1(28.65,0.66) v1(29.04,65.81) v1(30.9,45.16) v1(31.19,0.66) v1(31.24,68.93) v1(31.32,47.12) v1(32.86,54.93) v1(33.78,68.93) v1(33.73,0.66) v1(35.86,8.52) v1(36.27,0.66) v1(36.9,55.38) v1(37.22,54.22) v1(38.59,54.25) v1(38.81,0.66) v1(38.9,69.39) v1(41.35,0.66) v1(42.42,69.22) v1(43.47,1.65) v1(44.22,67.69) v1(44.59,66.27) v1(44.59,63.73) v1(44.59,61.19) v1(44.59,56.11) v1(44.59,53.57) v1(44.59,51.03) v1(44.59,48.49) v1(44.59,45.95) v1(44.59,43.41) v1(44.59,40.87) v1(44.59,38.33) v1(44.59,35.79) v1(44.59,33.25) v1(44.59,30.71) v1(44.59,28.17) v1(44.59,25.63) v1(44.59,23.09) v1(44.59,20.55) v1(44.59,18.01) v1(44.59,15.47) v1(44.59,14.66) v1(44.59,12.36) v1(44.59,9.52) v1(44.59,6.85) v1(44.59,3.83)
VCCPLLL: length 9.6
  Top Layer w0.381: U7.G10 29.7,38.09
  Bottom Layer w0.305: 29.19,45 29.19,44.99 29.19,38.75 29.76,38.18 C128.2
  Bottom Layer w0.381: L12.2 30.13,44.99 C127.2 30.11,45 29.19,45
  vias: v1(29.72,38.09)
VCCPLLR: length 11.6
  Top Layer w0.381: U7.K7 v1(25.7,34.09)
  Bottom Layer w0.305: v1(25.7,34.09) 26.19,33.61 26.19,28.85 25.93,28.59 24.11,28.59 23.69,28.17 C130.2
  Bottom Layer w0.381: C130.2 23.61,27.52 L13.2
(no net):
  vias: v1(40.07,53.63)
A6_IOR26B_JTAG_TDI: length 4.3
  Top Layer w0.109: RN1.4 16.28,62.13 16.43,62.28 17.12,62.28 17.43,62.59 TP14.1 17.42,62.97 16.51,63.88 U20.4
A7_IOR26A_JTAG_TCK: length 6
  Top Layer w0.109: R20.2 17.08,61.29 15.85,61.29 15.78,61.37 RN1.3 15.77,61.71 15.77,62.32 16.42,62.97 16.17,62.97 15.54,63.6 15.54,64.72 U20.5
A13_IOR32A_READY: length 4
  Top Layer w0.109: U7.A13 31.66,44.13 31.66,45.49 32.24,46.06 33.31,46.06
B8_IOR25B_JTAG_TMS: length 3.6
  Top Layer w0.109: RN1.1 14.78,61.78 TP11.1 13.51,63.05 U20.7
B10_IOR31B_RECFG: length 1.6
  Top Layer w0.109: U7.B10 v1(29.7,43.09)
  Bottom Layer w0.109: v1(29.7,43.09) 29.76,43.03 R136.2
B16_MODE1: length 4.3
  Top Layer w0.109: 35.28,42.63 35.75,42.63 36.3,43.18 36.3,45.03 36,45.33 R133.1
BOOT0: length 7.3
  Top Layer w0.109: v1(24.51,59.81) 24.49,59.8 23.84,59.8 ; v1(25.02,55.45) 25.02,55.46 U1.44
  Bottom Layer w0.109: v1(25.02,55.45) 25.02,59.3 v1(24.51,59.81) 24.51,59.39 24.4,59.28 R4.2
